# Altium schematic sheet 0019_Processor - POWER.SchDoc
size A3
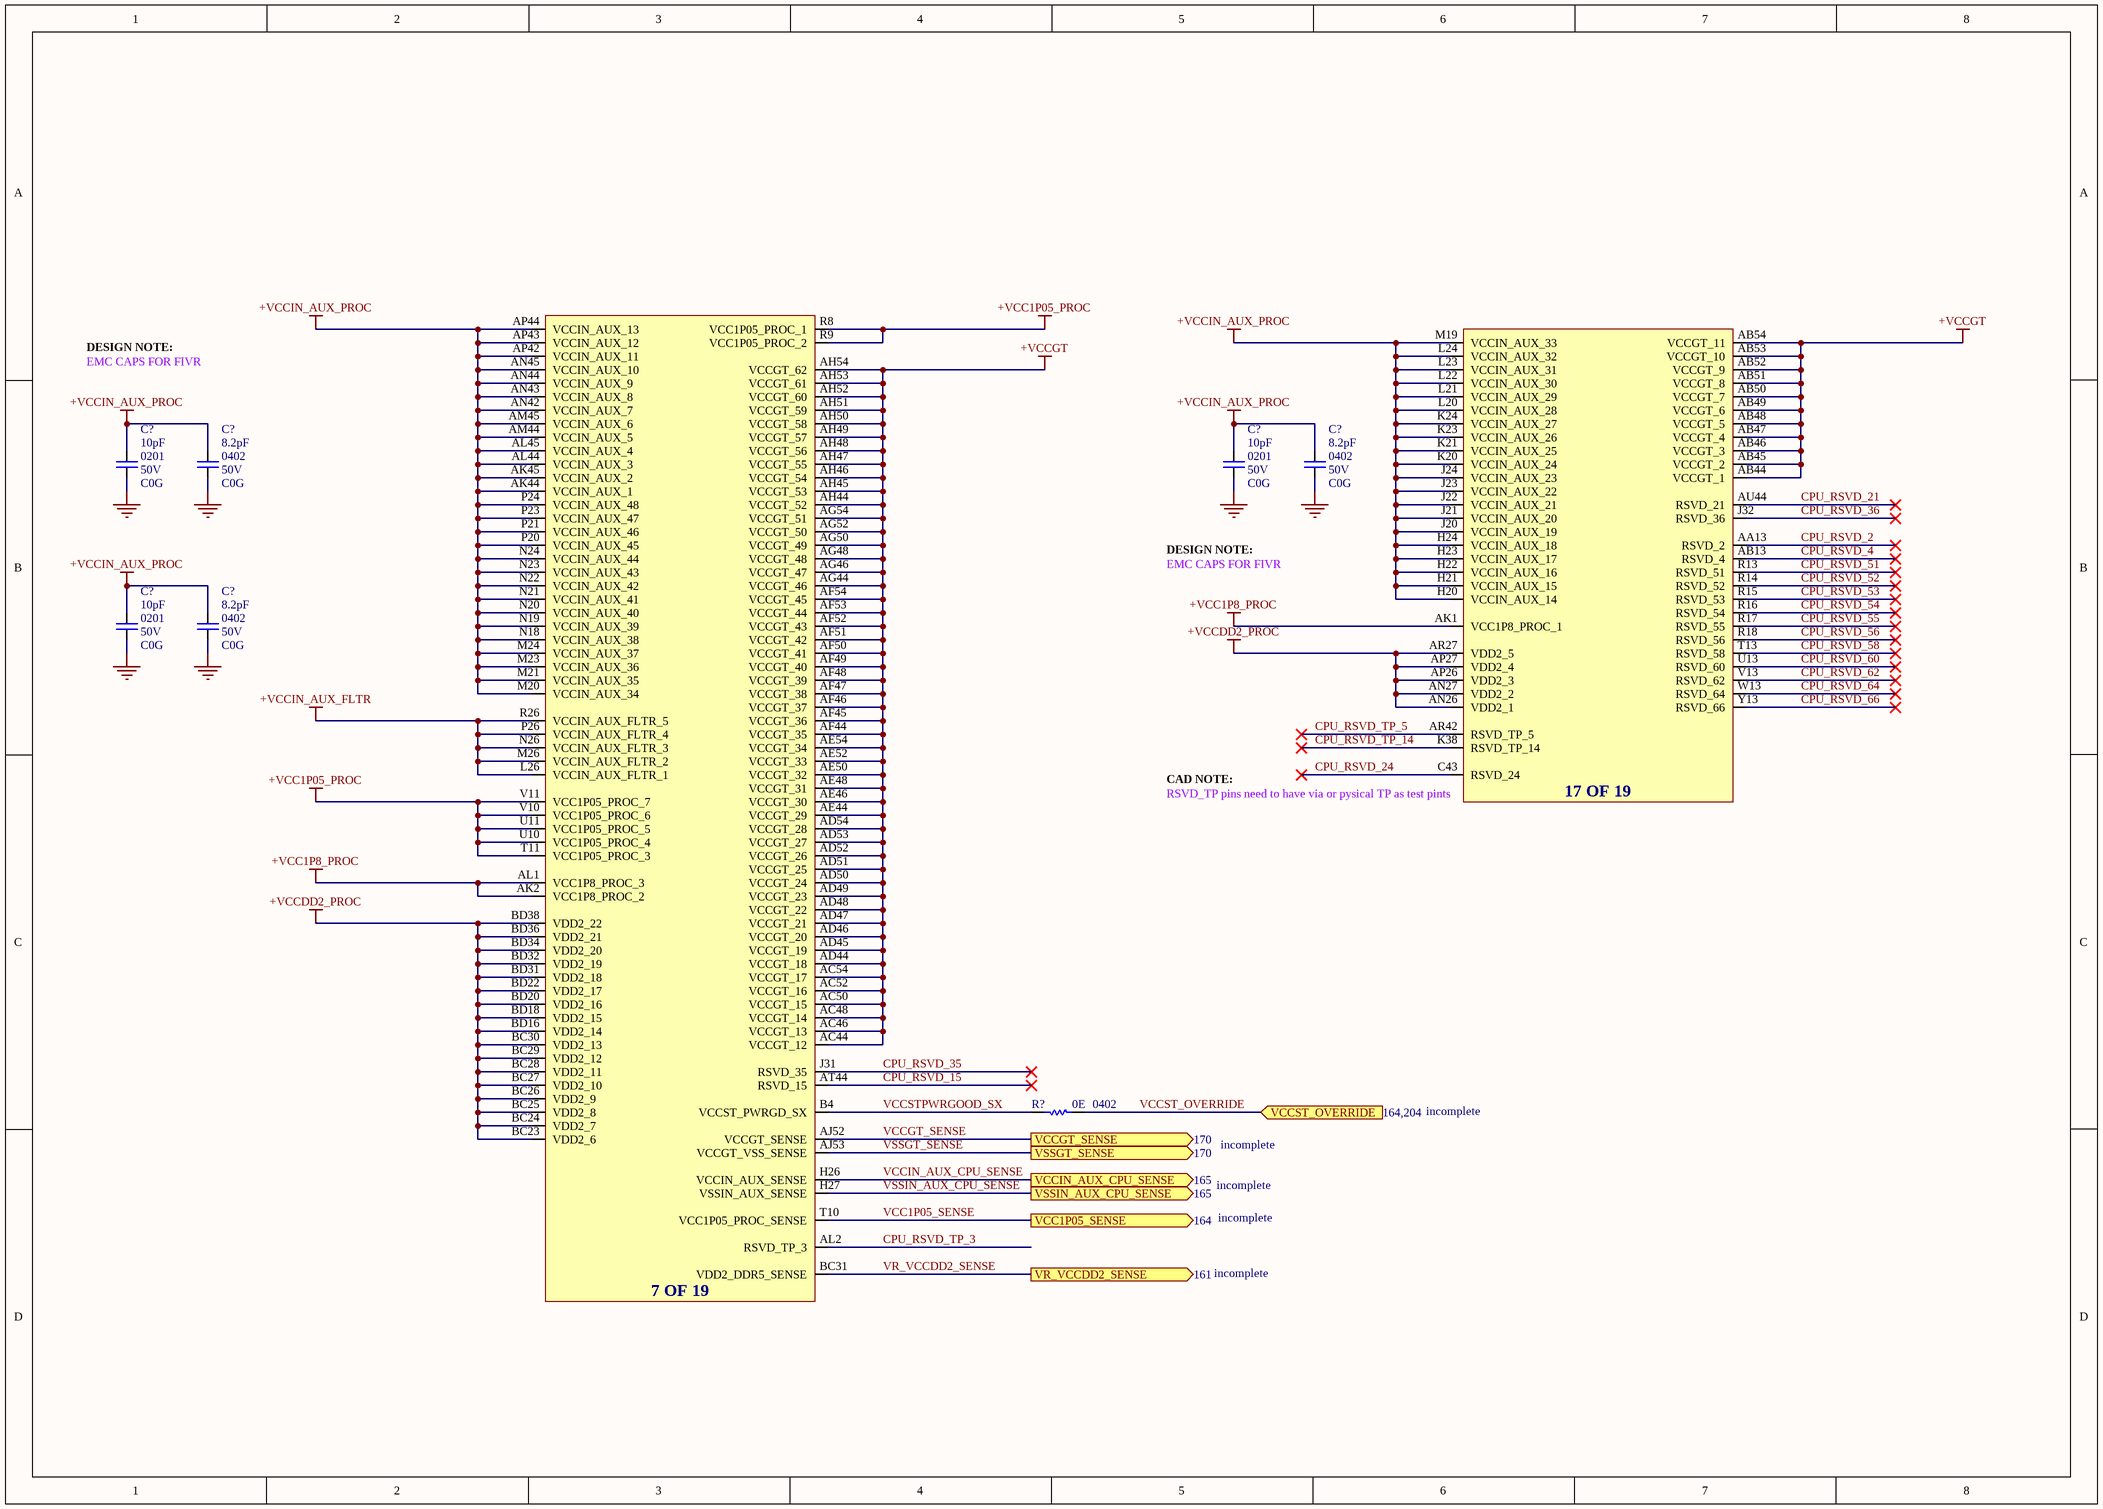
[diagram p0: 0019_Processor - POWER.SchDoc]

## Parts
(Parts that share a designator on the sheet are numbered #1, #2 ... from top to bottom, then left to right.)
C?#1  value 10pF  Case/Package: 0201  Voltage: 50V  Dielectric: C0G  [CAPC0201]
C?#2  value 8.2pF  Case/Package: 0402  Voltage: 50V  Dielectric: C0G  [capc0402]
C?#3  value 10pF  Case/Package: 0201  Voltage: 50V  Dielectric: C0G  [CAPC0201]
C?#4  value 8.2pF  Case/Package: 0402  Voltage: 50V  Dielectric: C0G  [capc0402]
C?#5  value 10pF  Case/Package: 0201  Voltage: 50V  Dielectric: C0G  [CAPC0201]
C?#6  value 8.2pF  Case/Package: 0402  Voltage: 50V  Dielectric: C0G  [capc0402]
R?  value 0E  Case/Package: 0402  [RESC0402]  (hidden comment: Res)
U1401  C_RPL_HX_EXT  (value not drawn)  (parts G,Q of 19)

## Ports
VCC1P05_SENSE (out), VCCGT_SENSE (out), VCCIN_AUX_CPU_SENSE (out), VCCST_OVERRIDE (in), VR_VCCDD2_SENSE (out), VSSGT_SENSE (out), VSSIN_AUX_CPU_SENSE (out)

## Nets
+VCC1P05_PROC: U1401.R8(VCC1P05_PROC_1) U1401.R9(VCC1P05_PROC_2) U1401.T11(VCC1P05_PROC_3) U1401.U10(VCC1P05_PROC_4) U1401.U11(VCC1P05_PROC_5) U1401.V10(VCC1P05_PROC_6) U1401.V11(VCC1P05_PROC_7)
+VCC1P8_PROC: U1401.AK1(VCC1P8_PROC_1) U1401.AK2(VCC1P8_PROC_2) U1401.AL1(VCC1P8_PROC_3)
+VCCDD2_PROC: U1401.AN26(VDD2_1) U1401.AN27(VDD2_2) U1401.AP26(VDD2_3) U1401.AP27(VDD2_4) U1401.AR27(VDD2_5) U1401.BC23(VDD2_6) U1401.BC24(VDD2_7) U1401.BC25(VDD2_8) U1401.BC26(VDD2_9) U1401.BC27(VDD2_10) U1401.BC28(VDD2_11) U1401.BC29(VDD2_12) U1401.BC30(VDD2_13) U1401.BD16(VDD2_14) U1401.BD18(VDD2_15) U1401.BD20(VDD2_16) U1401.BD22(VDD2_17) U1401.BD31(VDD2_18) U1401.BD32(VDD2_19) U1401.BD34(VDD2_20) U1401.BD36(VDD2_21) U1401.BD38(VDD2_22)
+VCCGT: U1401.AB44(VCCGT_1) U1401.AB45(VCCGT_2) U1401.AB46(VCCGT_3) U1401.AB47(VCCGT_4) U1401.AB48(VCCGT_5) U1401.AB49(VCCGT_6) U1401.AB50(VCCGT_7) U1401.AB51(VCCGT_8) U1401.AB52(VCCGT_9) U1401.AB53(VCCGT_10) U1401.AB54(VCCGT_11) U1401.AC44(VCCGT_12) U1401.AC46(VCCGT_13) U1401.AC48(VCCGT_14) U1401.AC50(VCCGT_15) U1401.AC52(VCCGT_16) U1401.AC54(VCCGT_17) U1401.AD44(VCCGT_18) U1401.AD45(VCCGT_19) U1401.AD46(VCCGT_20) U1401.AD47(VCCGT_21) U1401.AD48(VCCGT_22) U1401.AD49(VCCGT_23) U1401.AD50(VCCGT_24) U1401.AD51(VCCGT_25) U1401.AD52(VCCGT_26) U1401.AD53(VCCGT_27) U1401.AD54(VCCGT_28) U1401.AE44(VCCGT_29) U1401.AE46(VCCGT_30) U1401.AE48(VCCGT_31) U1401.AE50(VCCGT_32) U1401.AE52(VCCGT_33) U1401.AE54(VCCGT_34) U1401.AF44(VCCGT_35) U1401.AF45(VCCGT_36) U1401.AF46(VCCGT_37) U1401.AF47(VCCGT_38) U1401.AF48(VCCGT_39) U1401.AF49(VCCGT_40) U1401.AF50(VCCGT_41) U1401.AF51(VCCGT_42) U1401.AF52(VCCGT_43) U1401.AF53(VCCGT_44) U1401.AF54(VCCGT_45) U1401.AG44(VCCGT_46) U1401.AG46(VCCGT_47) U1401.AG48(VCCGT_48) U1401.AG50(VCCGT_49) U1401.AG52(VCCGT_50) U1401.AG54(VCCGT_51) U1401.AH44(VCCGT_52) U1401.AH45(VCCGT_53) U1401.AH46(VCCGT_54) U1401.AH47(VCCGT_55) U1401.AH48(VCCGT_56) U1401.AH49(VCCGT_57) U1401.AH50(VCCGT_58) U1401.AH51(VCCGT_59) U1401.AH52(VCCGT_60) U1401.AH53(VCCGT_61) U1401.AH54(VCCGT_62)
+VCCIN_AUX_FLTR: U1401.L26(VCCIN_AUX_FLTR_1) U1401.M26(VCCIN_AUX_FLTR_2) U1401.N26(VCCIN_AUX_FLTR_3) U1401.P26(VCCIN_AUX_FLTR_4) U1401.R26(VCCIN_AUX_FLTR_5)
+VCCIN_AUX_PROC: C?#1.1 C?#2.1 C?#3.1 C?#4.1 C?#5.1 C?#6.1 U1401.AK44(VCCIN_AUX_1) U1401.AK45(VCCIN_AUX_2) U1401.AL44(VCCIN_AUX_3) U1401.AL45(VCCIN_AUX_4) U1401.AM44(VCCIN_AUX_5) U1401.AM45(VCCIN_AUX_6) U1401.AN42(VCCIN_AUX_7) U1401.AN43(VCCIN_AUX_8) U1401.AN44(VCCIN_AUX_9) U1401.AN45(VCCIN_AUX_10) U1401.AP42(VCCIN_AUX_11) U1401.AP43(VCCIN_AUX_12) U1401.AP44(VCCIN_AUX_13) U1401.H20(VCCIN_AUX_14) U1401.H21(VCCIN_AUX_15) U1401.H22(VCCIN_AUX_16) U1401.H23(VCCIN_AUX_17) U1401.H24(VCCIN_AUX_18) U1401.J20(VCCIN_AUX_19) U1401.J21(VCCIN_AUX_20) U1401.J22(VCCIN_AUX_21) U1401.J23(VCCIN_AUX_22) U1401.J24(VCCIN_AUX_23) U1401.K20(VCCIN_AUX_24) U1401.K21(VCCIN_AUX_25) U1401.K23(VCCIN_AUX_26) U1401.K24(VCCIN_AUX_27) U1401.L20(VCCIN_AUX_28) U1401.L21(VCCIN_AUX_29) U1401.L22(VCCIN_AUX_30) U1401.L23(VCCIN_AUX_31) U1401.L24(VCCIN_AUX_32) U1401.M19(VCCIN_AUX_33) U1401.M20(VCCIN_AUX_34) U1401.M21(VCCIN_AUX_35) U1401.M23(VCCIN_AUX_36) U1401.M24(VCCIN_AUX_37) U1401.N18(VCCIN_AUX_38) U1401.N19(VCCIN_AUX_39) U1401.N20(VCCIN_AUX_40) U1401.N21(VCCIN_AUX_41) U1401.N22(VCCIN_AUX_42) U1401.N23(VCCIN_AUX_43) U1401.N24(VCCIN_AUX_44) U1401.P20(VCCIN_AUX_45) U1401.P21(VCCIN_AUX_46) U1401.P23(VCCIN_AUX_47) U1401.P24(VCCIN_AUX_48)
GND: C?#1.2 C?#2.2 C?#3.2 C?#4.2 C?#5.2 C?#6.2
CPU_RSVD_2: U1401.AA13(RSVD_2)
CPU_RSVD_4: U1401.AB13(RSVD_4)
CPU_RSVD_15: U1401.AT44(RSVD_15)
CPU_RSVD_21: U1401.AU44(RSVD_21)
CPU_RSVD_24: U1401.C43(RSVD_24)
CPU_RSVD_35: U1401.J31(RSVD_35)
CPU_RSVD_36: U1401.J32(RSVD_36)
CPU_RSVD_51: U1401.R13(RSVD_51)
CPU_RSVD_52: U1401.R14(RSVD_52)
CPU_RSVD_53: U1401.R15(RSVD_53)
CPU_RSVD_54: U1401.R16(RSVD_54)
CPU_RSVD_55: U1401.R17(RSVD_55)
CPU_RSVD_56: U1401.R18(RSVD_56)
CPU_RSVD_58: U1401.T13(RSVD_58)
CPU_RSVD_60: U1401.U13(RSVD_60)
CPU_RSVD_62: U1401.V13(RSVD_62)
CPU_RSVD_64: U1401.W13(RSVD_64)
CPU_RSVD_66: U1401.Y13(RSVD_66)
CPU_RSVD_TP_3: U1401.AL2(RSVD_TP_3)
CPU_RSVD_TP_5: U1401.AR42(RSVD_TP_5)
CPU_RSVD_TP_14: U1401.K38(RSVD_TP_14)
VCC1P05_SENSE: U1401.T10(VCC1P05_PROC_SENSE) ; port VCC1P05_SENSE
VCCGT_SENSE: U1401.AJ52(VCCGT_SENSE) ; port VCCGT_SENSE
VCCIN_AUX_CPU_SENSE: U1401.H26(VCCIN_AUX_SENSE) ; port VCCIN_AUX_CPU_SENSE
VCCST_OVERRIDE: R?.2 ; port VCCST_OVERRIDE
VCCSTPWRGOOD_SX: R?.1 U1401.B4(VCCST_PWRGD_SX)
VR_VCCDD2_SENSE: U1401.BC31(VDD2_DDR5_SENSE) ; port VR_VCCDD2_SENSE
VSSGT_SENSE: U1401.AJ53(VCCGT_VSS_SENSE) ; port VSSGT_SENSE
VSSIN_AUX_CPU_SENSE: U1401.H27(VSSIN_AUX_SENSE) ; port VSSIN_AUX_CPU_SENSE

## Notes on the sheet
- DESIGN NOTE:
- EMC CAPS FOR FIVR
- CAD NOTE:
- (near U1401) RSVD_TP pins need to have via or pysical TP as test pints
- incomplete
- (in symbol C_RPL_HX_EXT, part G) 7 OF 19
- (in symbol C_RPL_HX_EXT, part Q) 17 OF 19

## Library data of the parts
C?#1 C?#3 C?#5 = Cap: CAP CER 10pF 50V C0G 0201
C?#2 C?#4 C?#6 = Cap: CAP CER 8.2pF 50V C0G 0402
R? = Res: Thick Film Resistor -  0ohm, 1%, 0402